# EasyEDA Pro project PRO_project.eprj, schematic Schematic1 (continued)
## Sheets (continued)
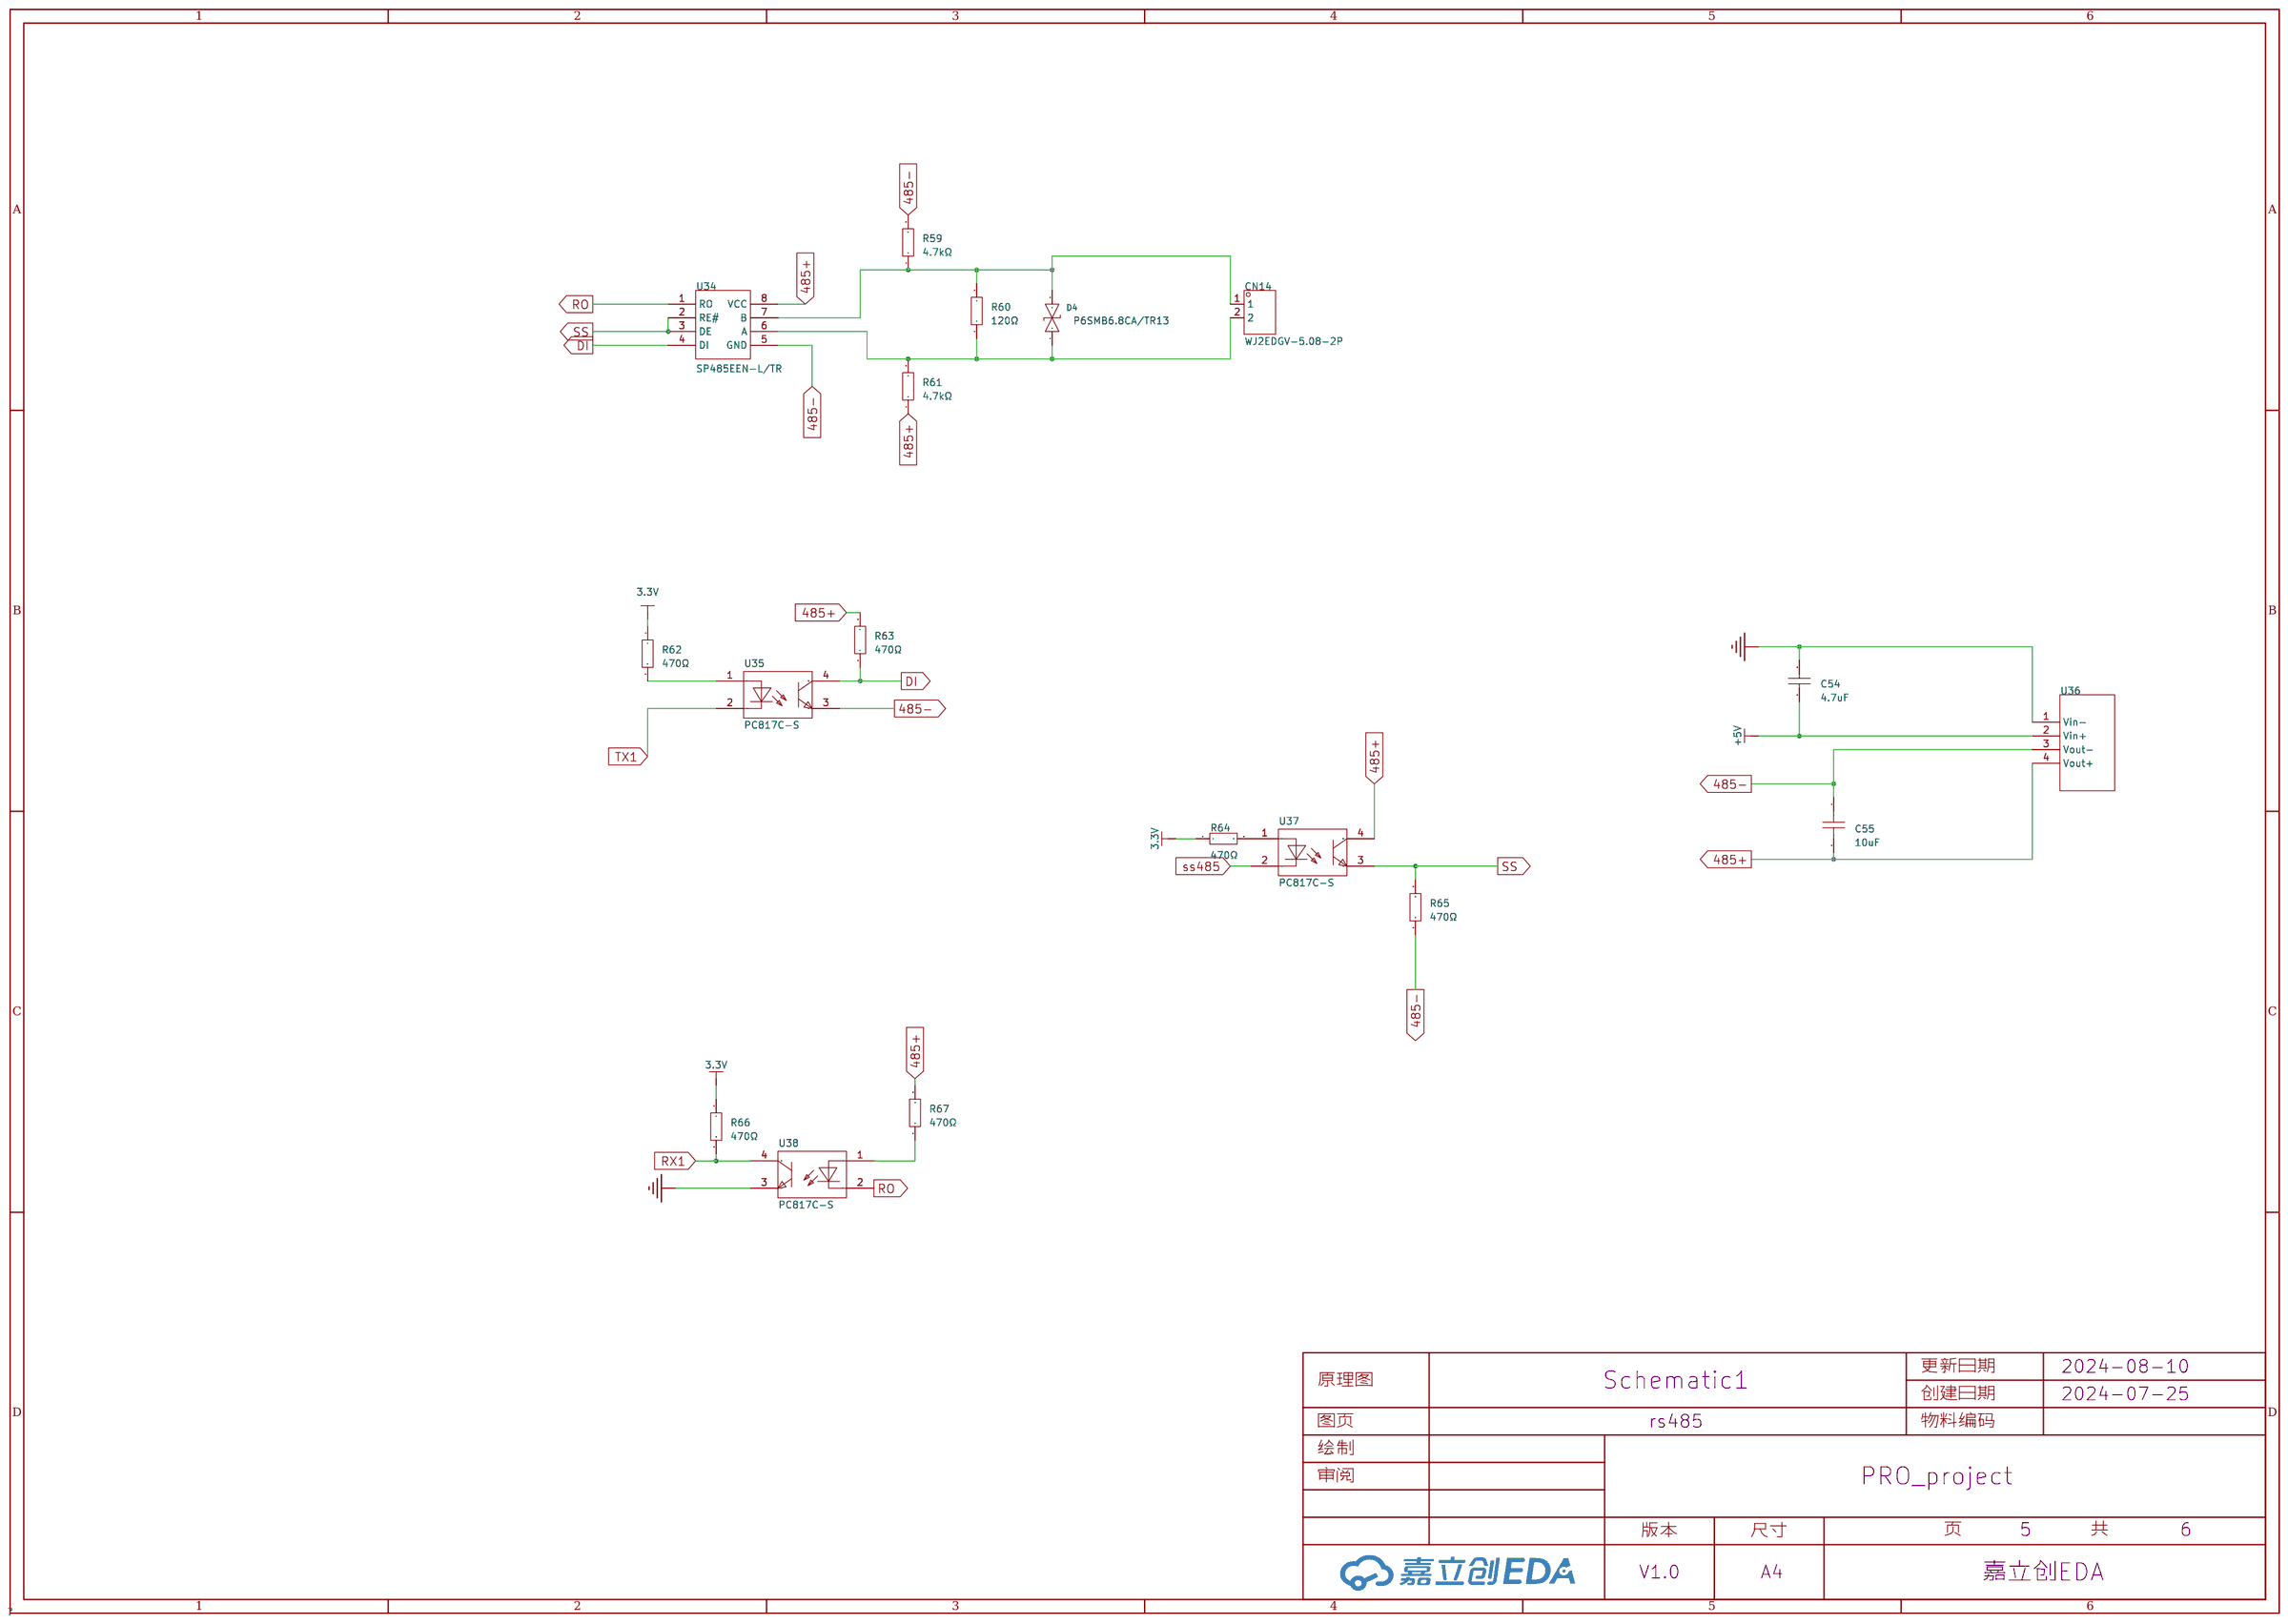
[diagram p3: rs485]
5 ADC: Page Name: ADC; Update Date: 2024-07-31
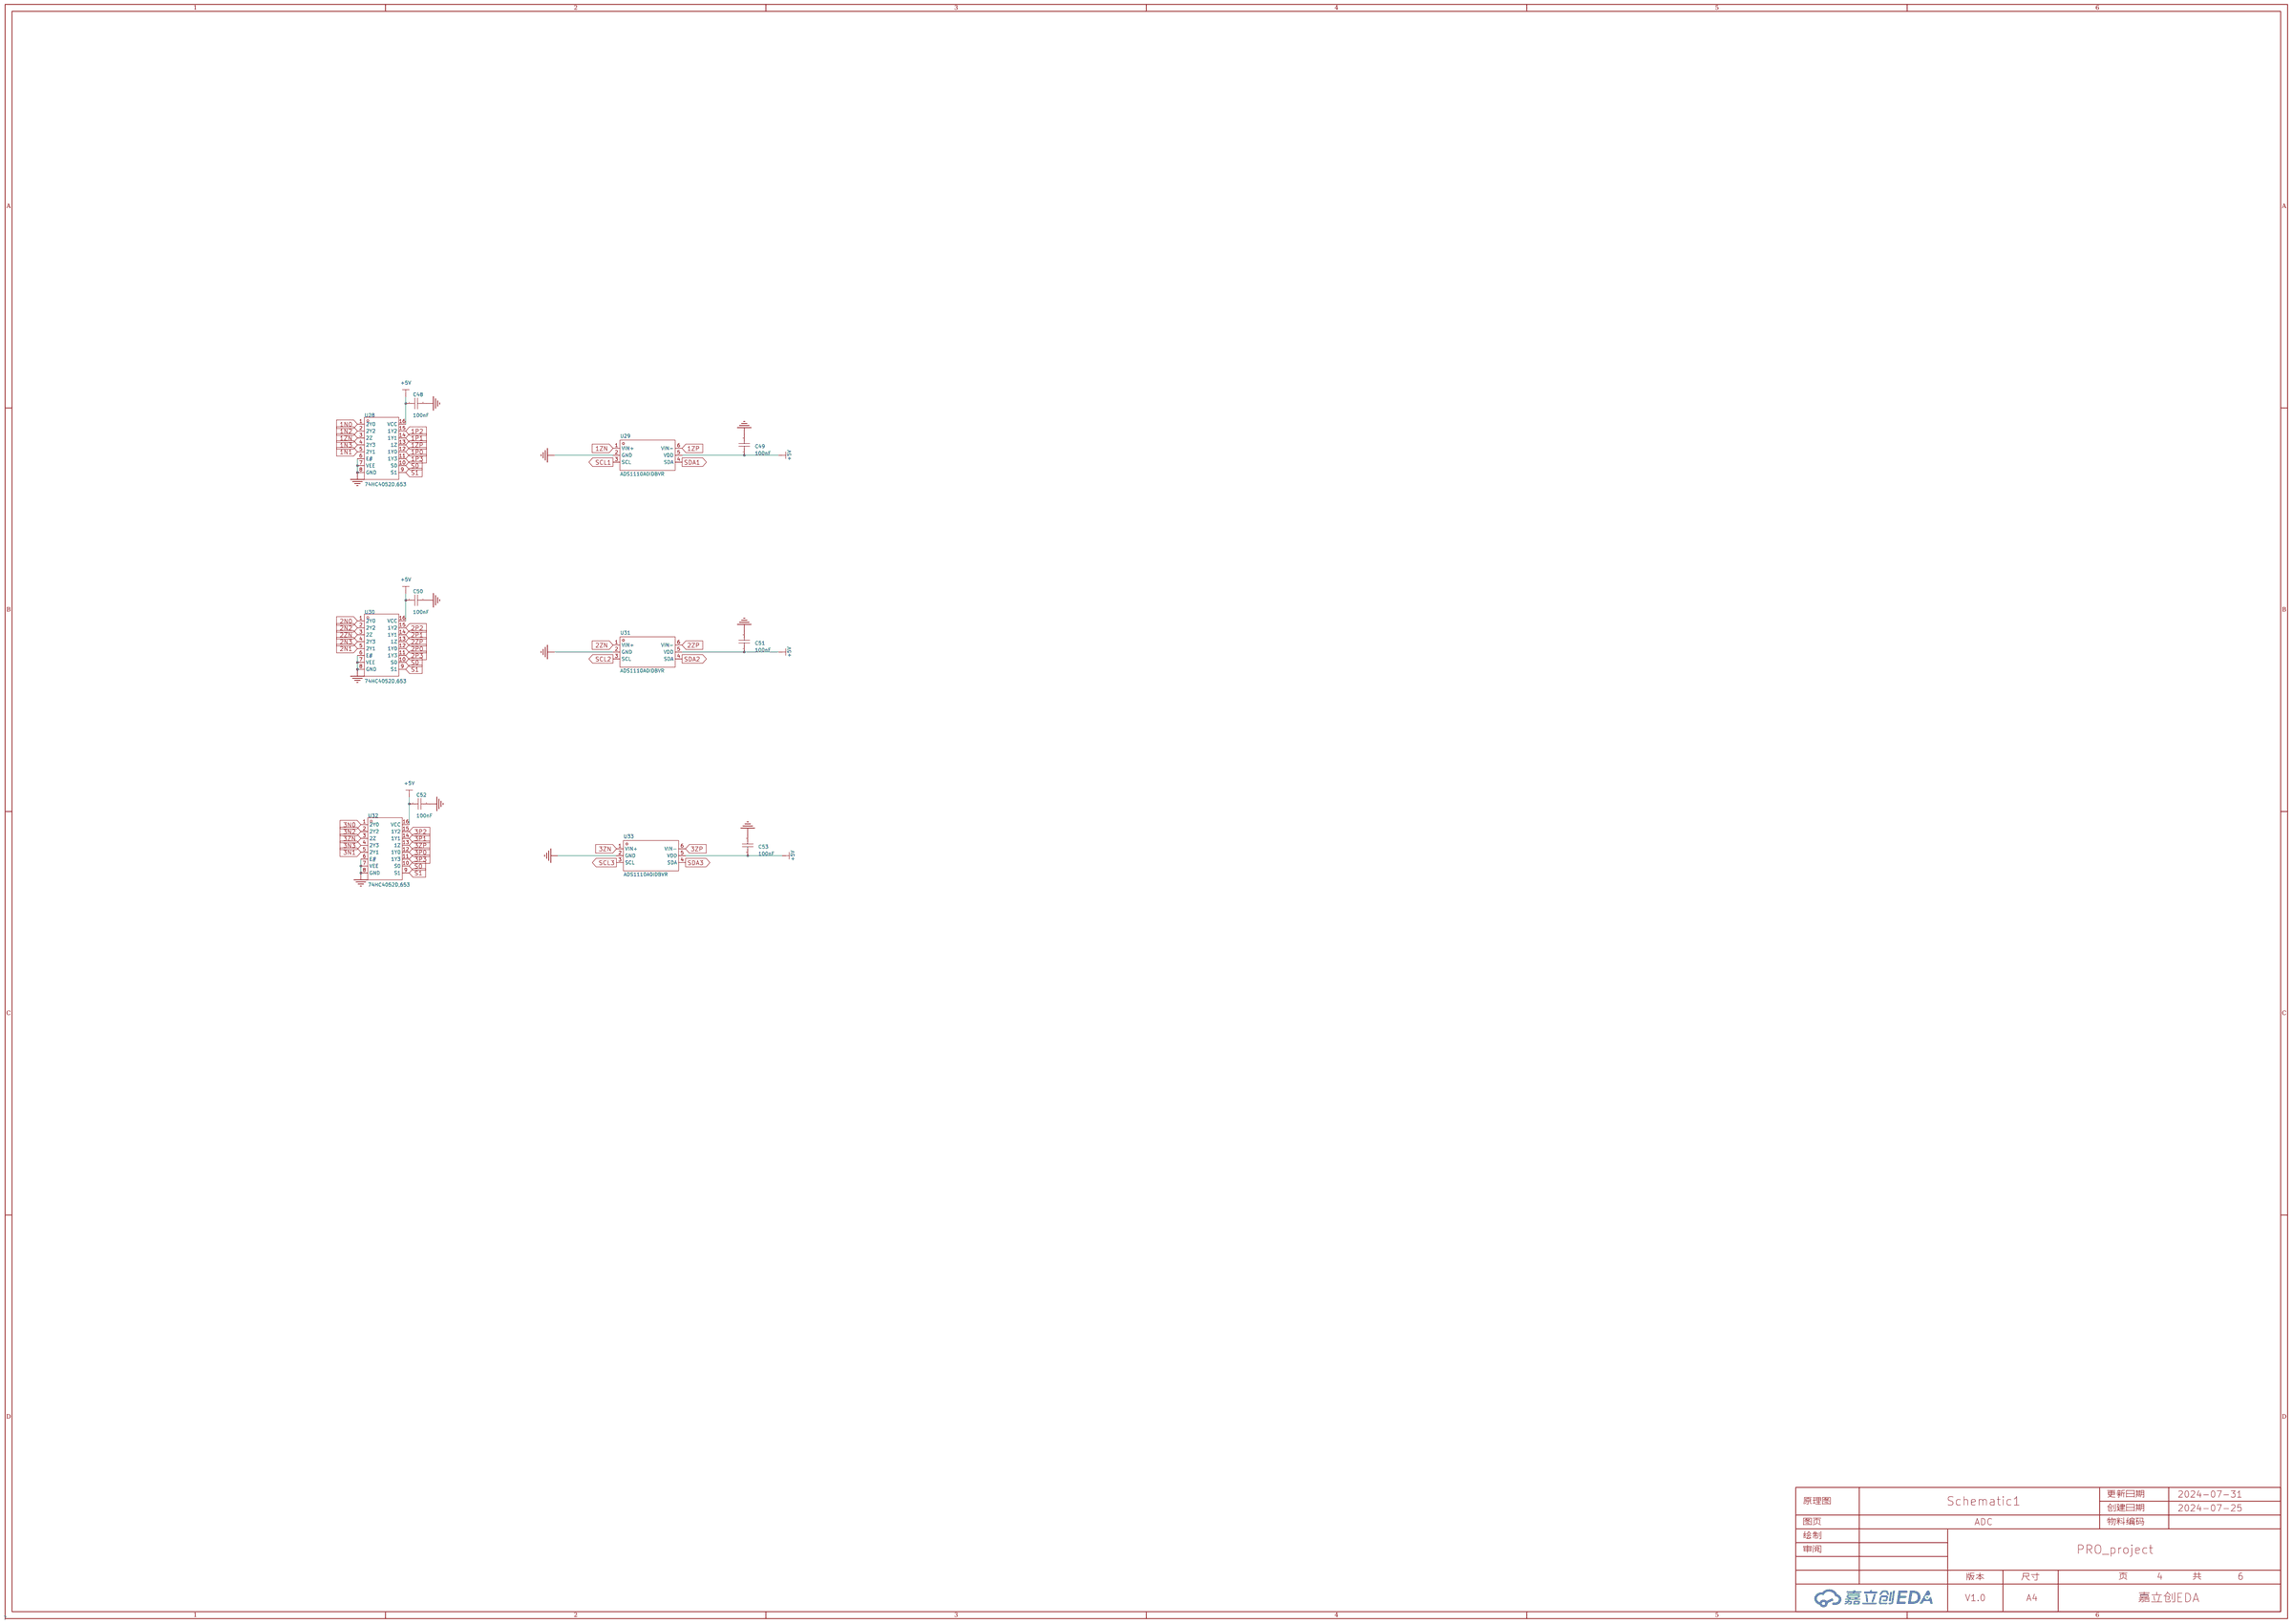
[diagram p4: ADC]
6 CAN: Create Date: 2024-07-26; Page Name: CAN; Update Date: 2024-07-26
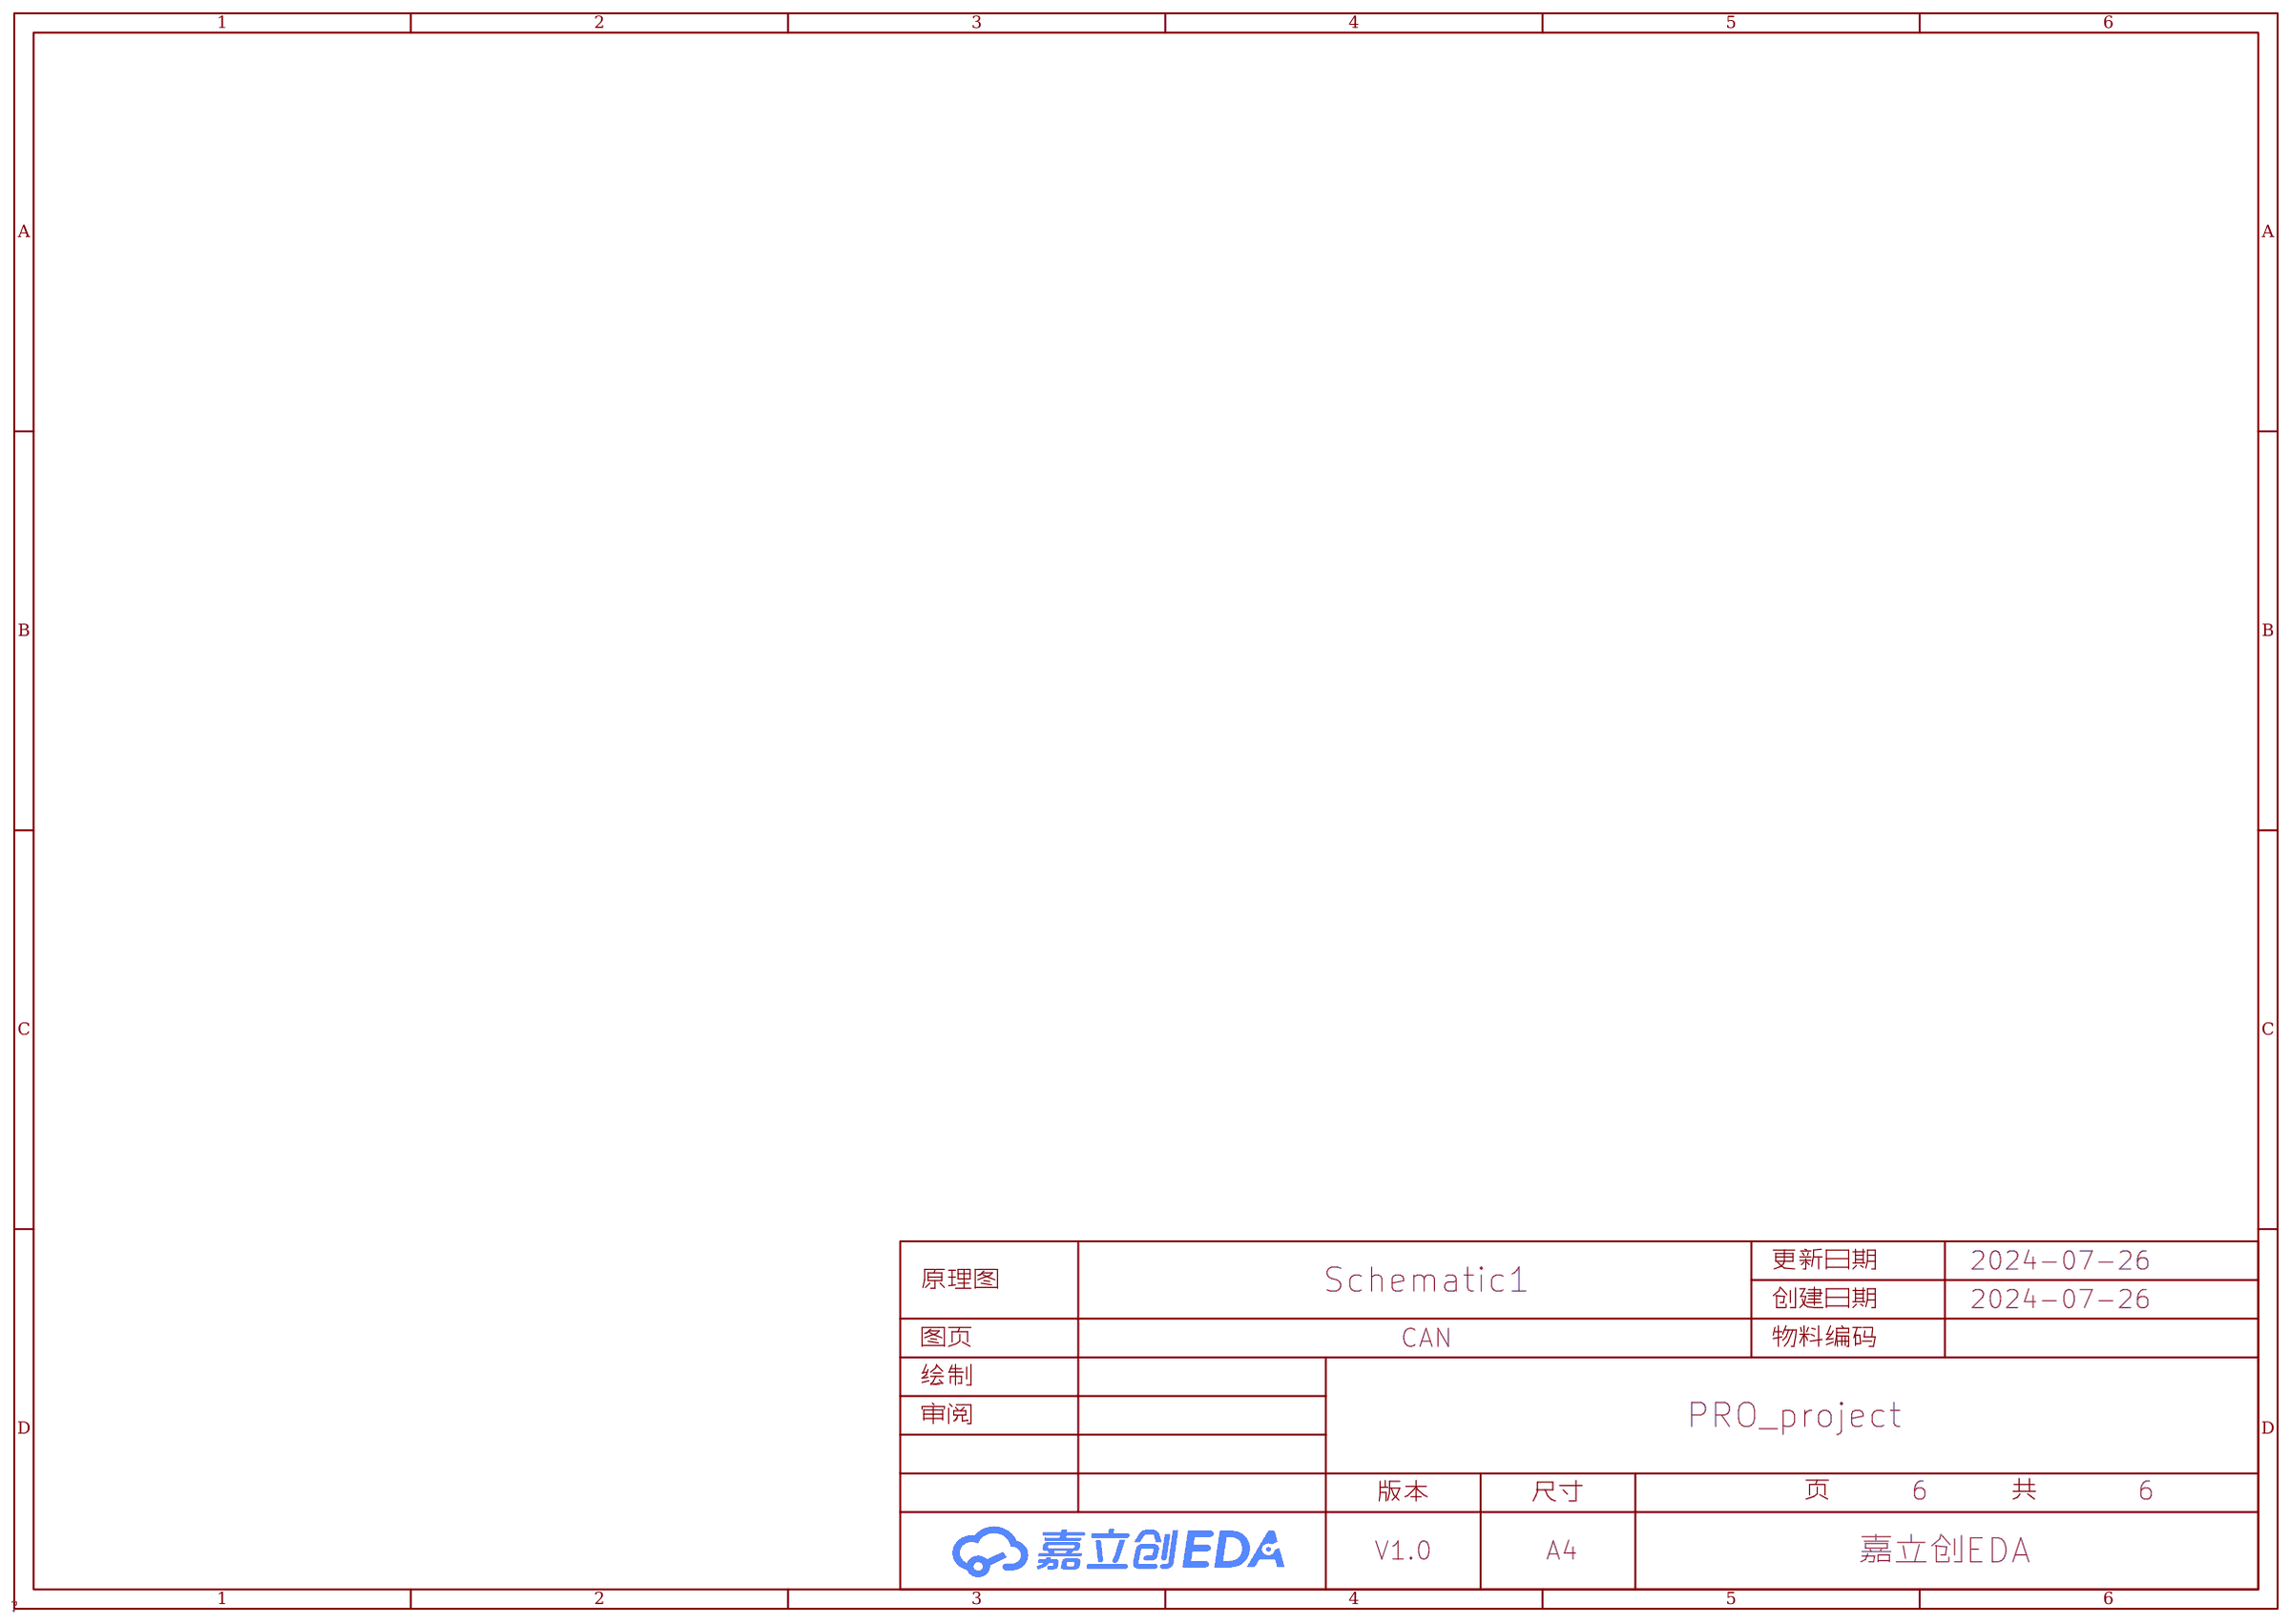
[diagram p5: CAN]

## Parts
sheet 74H
C12  330pF  [C0603]
C13  330pF  [C0603]
C14  330pF  [C0603]
C15  330pF  [C0603]
C16  10uF  [C0603]
C17  10uF  [C0603]
C18  10uF  [C0603]
C19  10uF  [C0603]
C20  4.7uF  [C0603]
C21  4.7uF  [C0603]
C22  4.7uF  [C0603]
C23  4.7uF  [C0603]
C24  330pF  [C0603]
C25  330pF  [C0603]
C26  330pF  [C0603]
C27  330pF  [C0603]
C28  10uF  [C0603]
C29  10uF  [C0603]
C30  10uF  [C0603]
C31  10uF  [C0603]
C32  4.7uF  [C0603]
C33  4.7uF  [C0603]
C34  4.7uF  [C0603]
C35  4.7uF  [C0603]
C36  330pF  [C0603]
C37  330pF  [C0603]
C38  330pF  [C0603]
C39  330pF  [C0603]
C40  10uF  [C0603]
C41  10uF  [C0603]
C42  10uF  [C0603]
C43  10uF  [C0603]
C44  4.7uF  [C0603]
C45  4.7uF  [C0603]
C46  4.7uF  [C0603]
C47  4.7uF  [C0603]
CN2  WJ2EDGV-5.08-2P  [CONN-TH_WJ2EDGV-5.08-2P]
CN3  WJ2EDGV-5.08-2P  [CONN-TH_WJ2EDGV-5.08-2P]
CN4  WJ2EDGV-5.08-2P  [CONN-TH_WJ2EDGV-5.08-2P]
CN5  WJ2EDGV-5.08-2P  [CONN-TH_WJ2EDGV-5.08-2P]
CN6  WJ2EDGV-5.08-2P  [CONN-TH_WJ2EDGV-5.08-2P]
CN7  WJ2EDGV-5.08-2P  [CONN-TH_WJ2EDGV-5.08-2P]
CN8  WJ2EDGV-5.08-2P  [CONN-TH_WJ2EDGV-5.08-2P]
CN9  WJ2EDGV-5.08-2P  [CONN-TH_WJ2EDGV-5.08-2P]
CN10  WJ2EDGV-5.08-2P  [CONN-TH_WJ2EDGV-5.08-2P]
CN11  WJ2EDGV-5.08-2P  [CONN-TH_WJ2EDGV-5.08-2P]
CN12  WJ2EDGV-5.08-2P  [CONN-TH_WJ2EDGV-5.08-2P]
CN13  WJ2EDGV-5.08-2P  [CONN-TH_WJ2EDGV-5.08-2P]
R11  82kΩ  [R0805]
R12  82kΩ  [R0805]
R13  82kΩ  [R0805]
R14  82kΩ  [R0805]
R15  82kΩ  [R0805]
R16  82kΩ  [R0805]
R17  82kΩ  [R0805]
R18  82kΩ  [R0805]
R19  3.24kΩ  [R0805]
R20  3.24kΩ  [R0805]
R21  3.24kΩ  [R0805]
R22  3.24kΩ  [R0805]
R23  3.24kΩ  [R0805]
R24  3.24kΩ  [R0805]
R25  3.24kΩ  [R0805]
R26  3.24kΩ  [R0805]
R27  82kΩ  [R0805]
R28  82kΩ  [R0805]
R29  82kΩ  [R0805]
R30  82kΩ  [R0805]
R31  82kΩ  [R0805]
R32  82kΩ  [R0805]
R33  82kΩ  [R0805]
R34  82kΩ  [R0805]
R35  3.24kΩ  [R0805]
R36  3.24kΩ  [R0805]
R37  3.24kΩ  [R0805]
R38  3.24kΩ  [R0805]
R39  3.24kΩ  [R0805]
R40  3.24kΩ  [R0805]
R41  3.24kΩ  [R0805]
R42  3.24kΩ  [R0805]
R43  82kΩ  [R0805]
R44  82kΩ  [R0805]
R45  82kΩ  [R0805]
R46  82kΩ  [R0805]
R47  82kΩ  [R0805]
R48  82kΩ  [R0805]
R49  82kΩ  [R0805]
R50  82kΩ  [R0805]
R51  3.24kΩ  [R0805]
R52  3.24kΩ  [R0805]
R53  3.24kΩ  [R0805]
R54  3.24kΩ  [R0805]
R55  3.24kΩ  [R0805]
R56  3.24kΩ  [R0805]
R57  3.24kΩ  [R0805]
R58  3.24kΩ  [R0805]
U4  AMC1200BDWVR  [SOIC-8_L5.9-W7.5-P1.27-LS11.5-BL]
U5  AMC1200BDWVR  [SOIC-8_L5.9-W7.5-P1.27-LS11.5-BL]
U6  AMC1200BDWVR  [SOIC-8_L5.9-W7.5-P1.27-LS11.5-BL]
U7  AMC1200BDWVR  [SOIC-8_L5.9-W7.5-P1.27-LS11.5-BL]
U8  -  [iCash-B0505-Right]
U9  -  [iCash-B0505-Right]
U10  -  [iCash-B0505-Right]
U11  -  [iCash-B0505-Right]
U12  AMC1200BDWVR  [SOIC-8_L5.9-W7.5-P1.27-LS11.5-BL]
U13  AMC1200BDWVR  [SOIC-8_L5.9-W7.5-P1.27-LS11.5-BL]
U14  AMC1200BDWVR  [SOIC-8_L5.9-W7.5-P1.27-LS11.5-BL]
U15  AMC1200BDWVR  [SOIC-8_L5.9-W7.5-P1.27-LS11.5-BL]
U16  -  [iCash-B0505-Right]
U17  -  [iCash-B0505-Right]
U18  -  [iCash-B0505-Right]
U19  -  [iCash-B0505-Right]
U20  AMC1200BDWVR  [SOIC-8_L5.9-W7.5-P1.27-LS11.5-BL]
U21  AMC1200BDWVR  [SOIC-8_L5.9-W7.5-P1.27-LS11.5-BL]
U22  AMC1200BDWVR  [SOIC-8_L5.9-W7.5-P1.27-LS11.5-BL]
U23  AMC1200BDWVR  [SOIC-8_L5.9-W7.5-P1.27-LS11.5-BL]
U24  -  [iCash-B0505-Right]
U25  -  [iCash-B0505-Right]
U26  -  [iCash-B0505-Right]
U27  -  [iCash-B0505-Right]
sheet ADC
C48  100nF  [C0402]
C49  100nF  [C0402]
C50  100nF  [C0402]
C51  100nF  [C0402]
C52  100nF  [C0402]
C53  100nF  [C0402]
U28  74HC4052D,653  [SOIC-16_L9.9-W3.9-P1.27-LS6.0-BL]
U29  ADS1110A0IDBVR  [SOT-23-6_L2.9-W1.6-P0.95-LS2.8-BR]
U30  74HC4052D,653  [SOIC-16_L9.9-W3.9-P1.27-LS6.0-BL]
U31  ADS1110A0IDBVR  [SOT-23-6_L2.9-W1.6-P0.95-LS2.8-BR]
U32  74HC4052D,653  [SOIC-16_L9.9-W3.9-P1.27-LS6.0-BL]
U33  ADS1110A0IDBVR  [SOT-23-6_L2.9-W1.6-P0.95-LS2.8-BR]
sheet mcu
C5  22pF  [C0805]
C6  22pF  [C0805]
C7  100nF  [C0402]
C8  10uF  [C0603]
C9  100nF  [C0402]
C10  100nF  [C0402]
C11  100nF  [C0402]
H1  PZ254V-11-04P  [HDR-TH_4P-P2.54-V-M]